# EasyEDA Pro project wukong01-Y003-HTOL.eprj, board PCB1 (continued)
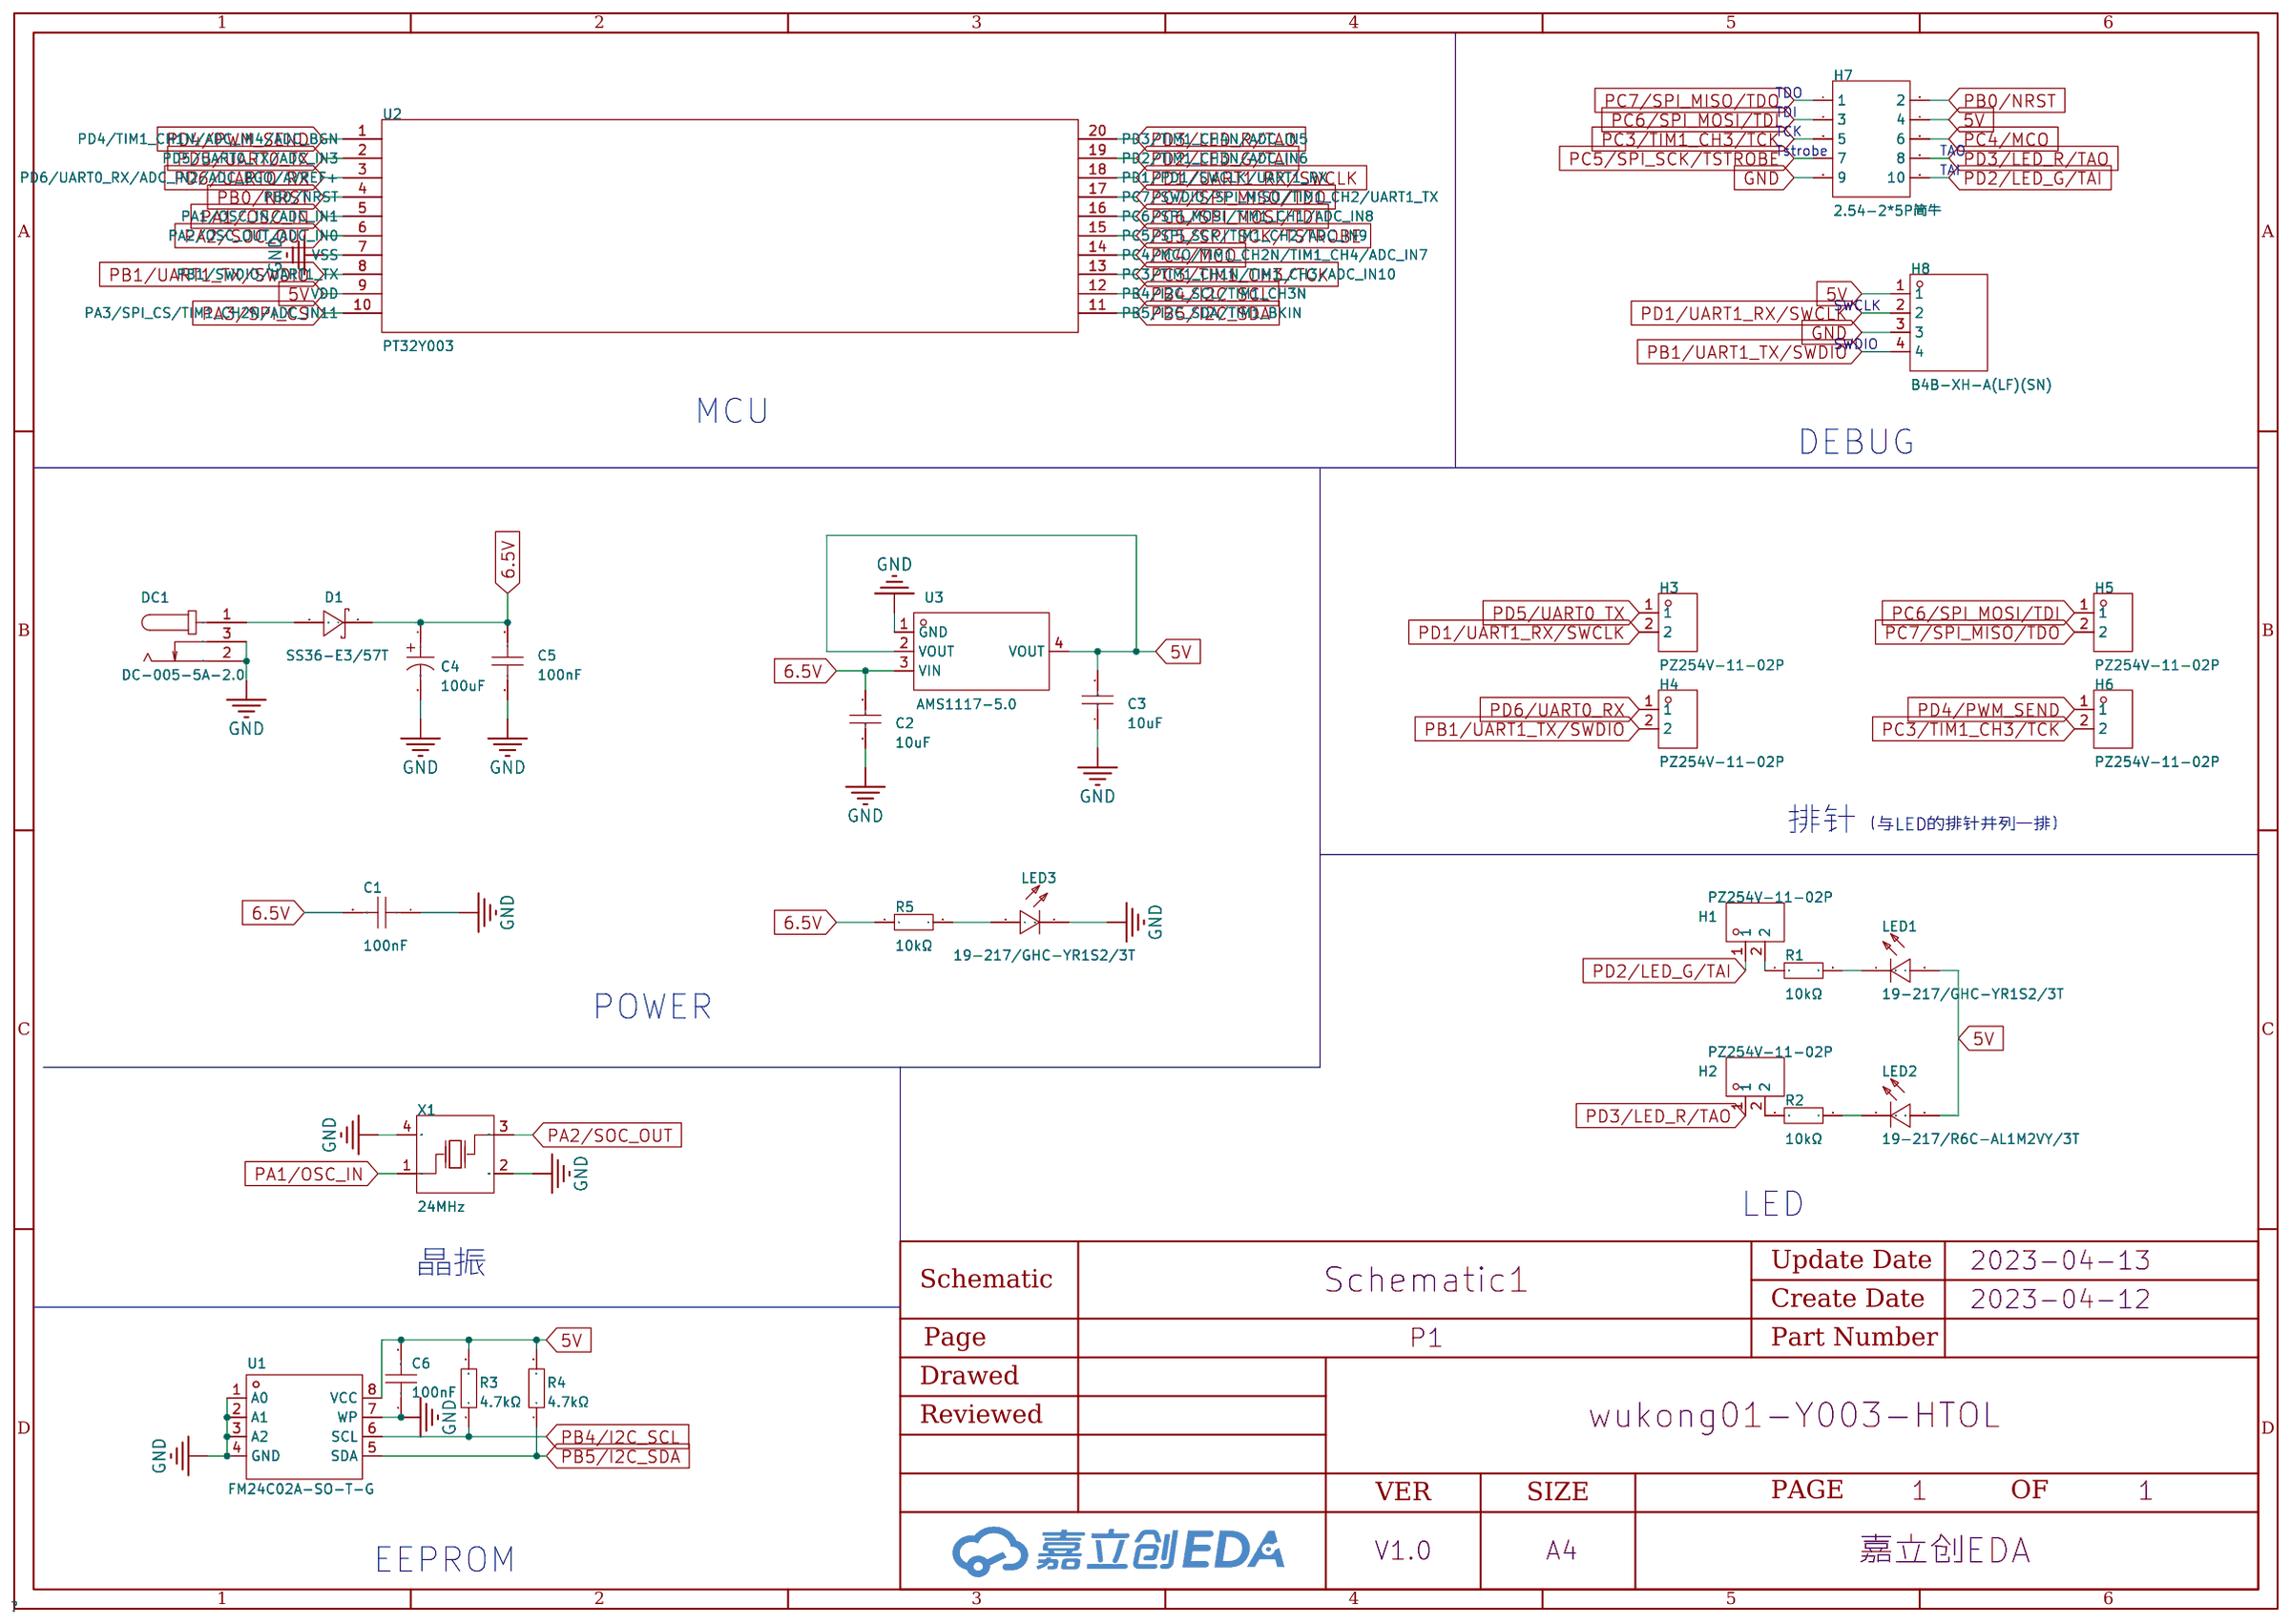
[diagram p0: schematic sheet]
## Routing (per net, layer and track width the routed paths; a pad name or vN(x,y) marks a point on that pad's centre or on a via; arc(x,y) is an arc through that point) (continued)
PC5/SPI_SCK/TSTROBE: length 727.1
  Top Layer w0.254: v1(37.34,102.62) 32.79,102.62 U2#8.15 ; v1(86.36,280.67) 86.36,280.92 81.91,285.37 H7#7.7 ; v1(282.45,151.89) 282.45,152.15 278,156.59 277.37,156.59 ; v1(37.34,231.39) 32.79,231.39 U2#29.15 ; v1(233.43,188.47) 228.88,188.47 U2#32.15 ; v1(233.43,151.89) 233.43,152.15 228.98,156.59 228.35,156.59 ; v1(233.43,237.74) 233.43,238 228.98,242.44 H7#27.7 ; v1(282.45,188.47) 277.9,188.47 U2#31.15 ; 179.32,156.59 179.96,156.59 184.4,152.15 v1(184.4,151.89) ; v1(135.38,145.54) 130.83,145.54 130.76,145.47 ; U2#35.15 32.79,188.47 v1(37.34,188.47) ; v1(184.4,102.62) 179.85,102.62 U2#6.15 ; v1(282.45,274.32) 277.9,274.32 U2#13.15 ; v1(135.38,231.39) 130.83,231.39 130.76,231.32 ; 130.3,285.37 130.94,285.37 135.38,280.92 v1(135.38,280.67) ; v1(86.36,66.04) 86.36,66.29 81.91,70.74 H7#15.7 ; v1(184.4,274.32) 179.85,274.32 U2#10.15 ; v1(282.45,102.62) 277.9,102.62 U2#3.15 ; H7#26.7 278,242.44 282.45,238 v1(282.45,237.74) ; 81.28,113.67 81.91,113.67 86.36,109.22 v1(86.36,108.97) ; v1(86.36,145.54) 81.81,145.54 U2#39.15 ; v1(135.38,237.74) 135.38,238 130.94,242.44 130.3,242.44 ; v1(184.4,108.97) 184.4,109.22 179.96,113.67 179.32,113.67 ; v1(37.34,66.04) 37.34,66.29 32.89,70.74 H7#12.7 ; v1(86.36,188.47) 81.81,188.47 U2#33.15 ; v1(37.34,59.69) 32.79,59.69 32.72,59.62 ; 179.32,27.81 179.96,27.81 184.4,23.37 v1(184.4,23.11) ; 228.35,113.67 228.98,113.67 233.43,109.22 v1(233.43,108.97) ; H7#33.7 228.98,199.52 233.43,195.07 v1(233.43,194.82) ; v1(233.43,66.04) 233.43,66.29 228.98,70.74 H7#22.7 ; v1(135.38,151.89) 135.38,152.15 130.94,156.59 130.3,156.59 ; U2#25.15 277.9,231.39 v1(282.45,231.39) ; U2#4.15 228.88,102.62 v1(233.43,102.62) ; U2#37.15 277.9,145.54 v1(282.45,145.54) ; v1(184.4,145.54) 179.85,145.54 U2#40.15 ; 228.8,59.62 228.88,59.69 v1(233.43,59.69) ; v1(37.34,16.76) 32.79,16.76 U2#22.15 ; v1(37.34,108.97) 37.34,109.22 32.89,113.67 32.26,113.67 ; H7#10.7 278,285.37 282.45,280.92 v1(282.45,280.67) ; v1(184.4,59.69) 179.85,59.69 179.78,59.62 ; H7#14.7 228.98,285.37 233.43,280.92 v1(233.43,280.67) ; v1(184.4,188.47) 179.85,188.47 U2#34.15 ; v1(135.38,66.04) 135.38,66.29 130.94,70.74 130.3,70.74 ; v1(184.4,237.74) 184.4,238 179.96,242.44 179.32,242.44 ; v1(37.34,237.74) 37.34,238 32.89,242.44 H7#28.7 ; v1(86.36,194.82) 86.36,195.07 81.91,199.52 H7#30.7 ; 277.83,59.62 277.9,59.69 v1(282.45,59.69) ; v1(184.4,231.39) 179.85,231.39 U2#28.15 ; 130.76,59.62 130.83,59.69 v1(135.38,59.69) ; v1(184.4,280.67) 184.4,280.92 179.96,285.37 179.32,285.37 ; v1(282.45,66.04) 282.45,66.29 278,70.74 H7#13.7 ; v1(86.36,16.76) 81.81,16.76 U2#23.15 ; 81.74,59.62 81.81,59.69 v1(86.36,59.69) ; v1(282.45,108.97) 282.45,109.22 278,113.67 277.37,113.67 ; v1(86.36,231.39) 81.81,231.39 U2#27.15 ; U2#26.15 228.88,231.39 v1(233.43,231.39) ; v1(184.4,16.76) 179.85,16.76 U2#17.15 ; 179.32,70.74 179.96,70.74 184.4,66.29 v1(184.4,66.04) ; 130.3,199.52 130.94,199.52 135.38,195.07 v1(135.38,194.82) ; U2#9.15 81.81,274.32 v1(86.36,274.32) ; 130.76,16.69 130.83,16.76 v1(135.38,16.76) ; v1(135.38,23.11) 135.38,23.37 130.94,27.81 130.3,27.81 ; 130.76,102.55 130.83,102.62 v1(135.38,102.62) ; U2#16.15 228.88,274.32 v1(233.43,274.32) ; v1(86.36,151.89) 86.36,152.15 81.91,156.59 81.28,156.59 ; 130.76,274.25 130.83,274.32 v1(135.38,274.32) ; 130.3,113.67 130.94,113.67 135.38,109.22 v1(135.38,108.97) ; v1(233.43,145.54) 228.88,145.54 U2#38.15 ; 32.26,156.59 32.89,156.59 37.34,152.15 v1(37.34,151.89) ; v1(282.45,194.82) 282.45,195.07 278,199.52 H7#32.7 ; U2#21.15 228.88,16.76 v1(233.43,16.76) ; v1(37.34,23.11) 37.34,23.37 32.89,27.81 32.26,27.81 ; v1(86.36,237.74) 86.36,238 81.91,242.44 H7#24.7 ; v1(184.4,194.82) 184.4,195.07 179.96,199.52 179.32,199.52 ; v1(135.38,188.47) 130.83,188.47 130.76,188.4 ; v1(233.43,23.11) 233.43,23.37 228.98,27.81 228.35,27.81 ; v1(86.36,23.11) 86.36,23.37 81.91,27.81 81.28,27.81 ; v1(37.34,194.82) 37.34,195.07 32.89,199.52 H7#34.7 ; v1(37.34,145.54) 32.79,145.54 U2.15 ; U2#5.15 81.81,102.62 v1(86.36,102.62)
  Bottom Layer w0.254: v1(37.34,145.54) v1(37.34,151.89) ; v1(86.36,16.76) v1(86.36,23.11) ; v1(233.43,102.62) v1(233.43,108.97) ; v1(135.38,188.47) v1(135.38,194.82) ; v1(37.34,16.76) v1(37.34,23.11) ; v1(184.4,188.47) v1(184.4,194.82) ; v1(233.43,59.69) v1(233.43,66.04) ; v1(135.38,274.32) v1(135.38,280.67) ; v1(233.43,188.47) v1(233.43,194.82) ; v1(233.43,16.76) v1(233.43,23.11) ; v1(86.36,274.32) v1(86.36,280.67) ; v1(135.38,59.69) v1(135.38,66.04) ; v1(184.4,231.39) v1(184.4,237.74) ; v1(282.45,231.39) v1(282.45,237.74) ; v1(135.38,16.76) v1(135.38,23.11) ; v1(282.45,59.69) v1(282.45,66.04) ; v1(184.4,16.76) v1(184.4,23.11) ; v1(37.34,231.39) v1(37.34,237.74) ; v1(282.45,188.47) v1(282.45,194.82) ; v1(37.34,59.69) v1(37.34,66.04) ; v1(282.45,102.62) v1(282.45,108.97) ; v1(135.38,231.39) v1(135.38,237.74) ; v1(86.36,145.54) v1(86.36,151.89) ; v1(37.34,102.62) v1(37.34,108.97) ; v1(233.43,274.32) v1(233.43,280.67) ; v1(184.4,145.54) v1(184.4,151.89) ; v1(86.36,188.47) v1(86.36,194.82) ; v1(135.38,102.62) v1(135.38,108.97) ; v1(184.4,274.32) v1(184.4,280.67) ; v1(233.43,145.54) v1(233.43,151.89) ; v1(233.43,231.39) v1(233.43,237.74) ; v1(86.36,59.69) v1(86.36,66.04) ; v1(282.45,274.32) v1(282.45,280.67) ; v1(86.36,231.39) v1(86.36,237.74) ; v1(86.36,102.62) v1(86.36,108.97) ; v1(135.38,145.54) v1(135.38,151.89) ; v1(184.4,102.62) v1(184.4,108.97) ; v1(184.4,59.69) v1(184.4,66.04) ; v1(37.34,188.47) v1(37.34,194.82) ; v1(282.45,145.54) v1(282.45,151.89)
PC6/SPI_MOSI/TDI: length 1347.5
  Top Layer w0.254: H5#18.1 191.2,10.92 184.72,17.4 v1(183.26,17.4) 183.21,17.34 U2#17.16 ; 27.18,70.74 27.18,67.44 27.81,66.8 35.43,66.8 v1(36.2,66.04) ; H5#9.1 191.2,268.48 184.72,274.96 v1(183.26,274.96) 183.21,274.9 U2#10.16 ; U2.16 36.14,146.12 v1(36.2,146.18) 37.66,146.18 44.13,139.7 H5#39.1 ; 130.76,60.27 134.18,60.27 v1(134.24,60.33) 135.7,60.33 142.18,53.85 H5#23.1 ; v1(183.26,23.11) 182.5,23.88 174.88,23.88 174.24,24.51 174.24,27.81 ; 272.29,113.67 272.29,110.36 272.92,109.73 280.54,109.73 v1(281.31,108.97) ; H5#19.1 142.18,10.92 135.7,17.4 v1(134.24,17.4) 134.18,17.34 130.76,17.34 ; H5#2.1 191.2,96.77 184.72,103.25 v1(183.26,103.25) 183.21,103.2 U2#6.16 ; 223.27,199.52 223.27,196.22 223.9,195.58 231.52,195.58 v1(232.28,194.82) ; U2#23.16 85.16,17.34 v1(85.22,17.4) 86.68,17.4 93.16,10.92 H5#14.1 ; v1(232.28,280.67) 231.52,281.43 223.9,281.43 223.27,282.07 223.27,285.37 ; H7#8.3 174.24,282.07 174.88,281.43 182.5,281.43 v1(183.26,280.67) ; U2#33.16 85.16,189.05 v1(85.22,189.1) 86.68,189.1 93.16,182.63 H5#32.1 ; U2#7.16 183.21,60.27 v1(183.26,60.33) 184.72,60.33 191.2,53.85 H5#16.1 ; v1(281.31,280.67) 280.54,281.43 272.92,281.43 272.29,282.07 H7#10.3 ; 174.24,156.59 174.24,153.29 174.88,152.65 182.5,152.65 v1(183.26,151.89) ; 27.18,199.52 27.18,196.22 27.81,195.58 35.43,195.58 v1(36.2,194.82) ; H5#4.1 93.16,96.77 86.68,103.25 v1(85.22,103.25) 85.16,103.2 U2#5.16 ; 130.76,274.9 134.18,274.9 v1(134.24,274.96) 135.7,274.96 142.18,268.48 H5#10.1 ; H5#38.1 93.16,139.7 86.68,146.18 v1(85.22,146.18) 85.16,146.12 U2#39.16 ; U2#37.16 281.25,146.12 v1(281.31,146.18) 282.77,146.18 289.24,139.7 H5#37.1 ; v1(85.22,194.82) 84.45,195.58 76.83,195.58 76.2,196.22 76.2,199.52 ; v1(232.28,66.04) 231.52,66.8 223.9,66.8 223.27,67.44 223.27,70.74 ; 223.27,156.59 223.27,153.29 223.9,152.65 231.52,152.65 v1(232.28,151.89) ; H7#25.3 174.24,239.14 174.88,238.51 182.5,238.51 v1(183.26,237.74) ; H5#34.1 240.22,182.63 233.74,189.1 v1(232.28,189.1) 232.23,189.05 U2#32.16 ; v1(183.26,66.04) 182.5,66.8 174.88,66.8 174.24,67.44 H7#16.3 ; U2#26.16 232.23,231.97 v1(232.28,232.03) 233.74,232.03 240.22,225.55 H5#28.1 ; 130.76,231.97 134.18,231.97 v1(134.24,232.03) 135.7,232.03 142.18,225.55 H5#29.1 ; 125.22,113.67 125.22,110.36 125.86,109.73 133.48,109.73 v1(134.24,108.97) ; H7#23.3 125.22,239.14 125.86,238.51 133.48,238.51 v1(134.24,237.74) ; H5#30.1 191.2,182.63 184.72,189.1 v1(183.26,189.1) 183.21,189.05 U2#34.16 ; v1(183.26,108.97) 182.5,109.73 174.88,109.73 174.24,110.36 174.24,113.67 ; U2#16.16 232.23,274.9 v1(232.28,274.96) 233.74,274.96 240.22,268.48 H5#12.1 ; 76.2,156.59 76.2,153.29 76.83,152.65 84.45,152.65 v1(85.22,151.89) ; U2#8.16 36.14,103.2 v1(36.2,103.25) 37.66,103.25 44.13,96.77 H5#5.1 ; U2#28.16 183.21,231.97 v1(183.26,232.03) 184.72,232.03 191.2,225.55 H5#24.1 ; v1(85.22,280.67) 84.45,281.43 76.83,281.43 76.2,282.07 76.2,285.37 ; 27.18,113.67 27.18,110.36 27.81,109.73 35.43,109.73 v1(36.2,108.97) ; v1(134.24,66.04) 133.48,66.8 125.86,66.8 125.22,67.44 H7#17.3 ; H7#32.3 272.29,196.22 272.92,195.58 280.54,195.58 v1(281.31,194.82) ; H5#25.1 289.24,225.55 282.77,232.03 v1(281.31,232.03) 281.25,231.97 U2#25.16 ; v1(85.22,66.04) 84.45,66.8 76.83,66.8 76.2,67.44 76.2,70.74 ; H5#15.1 93.16,53.85 86.68,60.33 v1(85.22,60.33) 85.16,60.27 U2#14.16 ; U2#21.16 232.23,17.34 v1(232.28,17.4) 233.74,17.4 240.22,10.92 H5#17.1 ; 125.22,156.59 125.22,153.29 125.86,152.65 133.48,152.65 v1(134.24,151.89) ; H5#36.1 191.2,139.7 184.72,146.18 v1(183.26,146.18) 183.21,146.12 U2#40.16 ; v1(36.2,151.89) 35.43,152.65 27.81,152.65 27.18,153.29 27.18,156.59 ; v1(36.2,23.11) 35.43,23.88 27.81,23.88 27.18,24.51 27.18,27.81 ; U2#13.16 281.25,274.9 v1(281.31,274.96) 282.77,274.96 289.24,268.48 H5#11.1 ; v1(134.24,280.67) 133.48,281.43 125.86,281.43 125.22,282.07 H7#9.3 ; H5#40.1 240.22,139.7 233.74,146.18 v1(232.28,146.18) 232.23,146.12 U2#38.16 ; U2#29.16 36.14,231.97 v1(36.2,232.03) 37.66,232.03 44.13,225.55 H5#27.1 ; U2#19.16 232.23,60.27 v1(232.28,60.33) 233.74,60.33 240.22,53.85 H5#20.1 ; U2#3.16 281.25,103.2 v1(281.31,103.25) 282.77,103.25 289.24,96.77 H5#3.1 ; U2#27.16 85.16,231.97 v1(85.22,232.03) 86.68,232.03 93.16,225.55 H5#26.1 ; H5#6.1 240.22,96.77 233.74,103.25 v1(232.28,103.25) 232.23,103.2 U2#4.16 ; H5#7.1 142.18,96.77 135.7,103.25 v1(134.24,103.25) 134.18,103.2 130.76,103.2 ; H7#29.3 125.22,196.22 125.86,195.58 133.48,195.58 v1(134.24,194.82) ; v1(281.31,151.89) 280.54,152.65 272.92,152.65 272.29,153.29 272.29,156.59 ; H5#13.1 289.24,53.85 282.77,60.33 v1(281.31,60.33) 281.25,60.27 U2#12.16 ; H7#31.3 174.24,196.22 174.88,195.58 182.5,195.58 v1(183.26,194.82) ; 223.27,113.67 223.27,110.36 223.9,109.73 231.52,109.73 v1(232.28,108.97) ; H5#21.1 44.13,10.92 37.66,17.4 v1(36.2,17.4) 36.14,17.34 U2#22.16 ; H5#31.1 289.24,182.63 282.77,189.1 v1(281.31,189.1) 281.25,189.05 U2#31.16 ; v1(232.28,23.11) 231.52,23.88 223.9,23.88 223.27,24.51 223.27,27.81 ; 76.2,113.67 76.2,110.36 76.83,109.73 84.45,109.73 v1(85.22,108.97) ; 27.18,242.44 27.18,239.14 27.81,238.51 35.43,238.51 v1(36.2,237.74) ; H5#35.1 142.18,182.63 135.7,189.1 v1(134.24,189.1) 134.18,189.05 130.76,189.05 ; H5#8.1 93.16,268.48 86.68,274.96 v1(85.22,274.96) 85.16,274.9 U2#9.16 ; U2#20.16 36.14,60.27 v1(36.2,60.33) 37.66,60.33 44.13,53.85 H5#22.1 ; H5.1 142.18,139.7 135.7,146.18 v1(134.24,146.18) 134.18,146.12 130.76,146.12 ; 125.22,27.81 125.22,24.51 125.86,23.88 133.48,23.88 v1(134.24,23.11) ; U2#35.16 36.14,189.05 v1(36.2,189.1) 37.66,189.1 44.13,182.63 H5#33.1 ; H7#26.3 272.29,239.14 272.92,238.51 280.54,238.51 v1(281.31,237.74) ; v1(85.22,23.11) 84.45,23.88 76.83,23.88 76.2,24.51 76.2,27.81 ; H7#13.3 272.29,67.44 272.92,66.8 280.54,66.8 v1(281.31,66.04) ; v1(85.22,237.74) 84.45,238.51 76.83,238.51 76.2,239.14 76.2,242.44 ; 223.27,242.44 223.27,239.14 223.9,238.51 231.52,238.51 v1(232.28,237.74)
  Bottom Layer w0.254: v1(134.24,189.1) v1(134.24,194.82) ; v1(183.26,189.1) v1(183.26,194.82) ; v1(281.31,189.1) v1(281.31,194.82) ; v1(183.26,274.96) v1(183.26,280.67) ; v1(232.28,189.1) v1(232.28,194.82) ; v1(134.24,274.96) v1(134.24,280.67) ; v1(85.22,274.96) v1(85.22,280.67) ; v1(281.31,274.96) v1(281.31,280.67) ; v1(134.24,17.4) v1(134.24,23.11) ; v1(183.26,232.03) v1(183.26,237.74) ; v1(85.22,17.4) v1(85.22,23.11) ; v1(281.31,232.03) v1(281.31,237.74) ; v1(134.24,60.33) v1(134.24,66.04) ; v1(232.28,274.96) v1(232.28,280.67) ; v1(281.31,60.33) v1(281.31,66.04) ; v1(85.22,232.03) v1(85.22,237.74) ; v1(85.22,103.25) v1(85.22,108.97) ; v1(85.22,189.1) v1(85.22,194.82) ; v1(85.22,60.33) v1(85.22,66.04) ; v1(36.2,60.33) v1(36.2,66.04) ; v1(134.24,146.18) v1(134.24,151.89) ; v1(36.2,189.1) v1(36.2,194.82) ; v1(232.28,103.25) v1(232.28,108.97) ; v1(183.26,17.4) v1(183.26,23.11) ; v1(36.2,17.4) v1(36.2,23.11) ; v1(134.24,232.03) v1(134.24,237.74) ; v1(232.28,17.4) v1(232.28,23.11) ; v1(232.28,232.03) v1(232.28,237.74) ; v1(134.24,103.25) v1(134.24,108.97) ; v1(183.26,146.18) v1(183.26,151.89) ; v1(183.26,60.33) v1(183.26,66.04) ; v1(36.2,232.03) v1(36.2,237.74) ; v1(36.2,103.25) v1(36.2,108.97) ; v1(85.22,146.18) v1(85.22,151.89) ; v1(232.28,146.18) v1(232.28,151.89) ; v1(281.31,146.18) v1(281.31,151.89) ; v1(36.2,146.18) v1(36.2,151.89) ; v1(183.26,103.25) v1(183.26,108.97) ; v1(232.28,60.33) v1(232.28,66.04) ; v1(281.31,103.25) v1(281.31,108.97)
PC7/SPI_MISO/TDO: length 1602.9
  Top Layer w0.254: H7#7.1 73.66,281.56 74.3,280.92 83.82,280.92 v1(84.07,280.67) ; 130.76,146.77 130.8,146.81 v1(133.1,146.81) ; v1(87.12,185.8) 91.82,181.1 96.39,181.1 96.65,181.36 H5#32.2 ; v1(87.12,271.65) 91.82,266.95 96.39,266.95 96.65,267.21 H5#8.2 ; v1(35.05,194.82) 34.8,195.07 25.27,195.07 24.64,195.71 24.64,199.52 ; v1(231.14,275.59) 228.84,275.59 U2#16.17 ; H5#13.2 292.74,52.58 292.48,52.32 287.91,52.32 v1(283.21,57.02) ; H5#9.2 194.69,267.21 194.44,266.95 189.87,266.95 v1(185.17,271.65) ; 122.68,113.67 122.68,109.86 123.32,109.22 132.84,109.22 v1(133.1,108.97) ; H5#34.2 243.71,181.36 243.46,181.1 238.89,181.1 v1(234.19,185.8) ; H5#15.2 96.65,52.58 96.39,52.32 91.82,52.32 v1(87.12,57.02) ; v1(133.1,280.67) 132.84,280.92 123.32,280.92 122.68,281.56 H7#9.1 ; 73.66,113.67 73.66,109.86 74.3,109.22 83.82,109.22 v1(84.07,108.97) ; v1(280.16,275.59) 277.87,275.59 U2#13.17 ; v1(231.14,189.74) 228.84,189.74 228.8,189.7 ; 81.74,17.99 81.78,18.03 v1(84.07,18.03) ; v1(133.1,237.74) 132.84,238 123.32,238 122.68,238.63 H7#23.1 ; U2#8.17 32.76,103.89 v1(35.05,103.89) ; U2#20.17 32.76,60.96 v1(35.05,60.96) ; 269.75,113.67 269.75,109.86 270.38,109.22 279.91,109.22 v1(280.16,108.97) ; v1(38.1,14.1) 42.8,9.4 47.37,9.4 47.62,9.65 H5#21.2 ; v1(234.19,14.1) 238.89,9.4 243.46,9.4 243.71,9.65 H5#17.2 ; H7#10.1 269.75,281.56 270.38,280.92 279.91,280.92 v1(280.16,280.67) ; v1(84.07,66.04) 83.82,66.29 74.3,66.29 73.66,66.93 H7#15.1 ; H5#12.2 243.71,267.21 243.46,266.95 238.89,266.95 v1(234.19,271.65) ; v1(35.05,23.11) 34.8,23.37 25.27,23.37 24.64,24 24.64,27.81 ; H5#31.2 292.74,181.36 292.48,181.1 287.91,181.1 v1(283.21,185.8) ; H5#33.2 47.62,181.36 47.37,181.1 42.8,181.1 v1(38.1,185.8) ; H5#27.2 47.62,224.28 47.37,224.03 42.8,224.03 v1(38.1,228.73) ; v1(38.1,57.02) 42.8,52.32 47.37,52.32 47.62,52.58 H5#22.2 ; v1(35.05,146.81) 32.76,146.81 U2.17 ; H5#18.2 194.69,9.65 194.44,9.4 189.87,9.4 v1(185.17,14.1) ; v1(133.1,194.82) 132.84,195.07 123.32,195.07 122.68,195.71 H7#29.1 ; v1(182.12,189.74) 179.82,189.74 179.78,189.7 ; 171.7,156.59 171.7,152.78 172.34,152.15 181.86,152.15 v1(182.12,151.89) ; U2#10.17 179.82,275.59 v1(182.12,275.59) ; v1(87.12,99.95) 91.82,95.25 96.39,95.25 96.65,95.5 H5#4.2 ; v1(280.16,189.74) 277.87,189.74 277.83,189.7 ; v1(231.14,23.11) 230.89,23.37 221.36,23.37 220.73,24 220.73,27.81 ; U2#26.17 228.84,232.66 v1(231.14,232.66) ; 171.7,113.67 171.7,109.86 172.34,109.22 181.86,109.22 v1(182.12,108.97) ; U2#14.17 81.78,60.96 v1(84.07,60.96) ; v1(182.12,23.11) 181.86,23.37 172.34,23.37 171.7,24 171.7,27.81 ; v1(133.1,103.89) 130.8,103.89 130.76,103.84 ; H5#14.2 96.65,9.65 96.39,9.4 91.82,9.4 v1(87.12,14.1) ; v1(182.12,194.82) 181.86,195.07 172.34,195.07 171.7,195.71 171.7,199.52 ; U2#7.17 179.82,60.96 v1(182.12,60.96) ; v1(136.14,99.95) 140.84,95.25 145.41,95.25 145.67,95.5 H5#7.2 ; 32.72,17.99 32.76,18.03 v1(35.05,18.03) ; v1(133.1,232.66) 130.8,232.66 130.76,232.62 ; 269.75,156.59 269.75,152.78 270.38,152.15 279.91,152.15 v1(280.16,151.89) ; v1(234.19,99.95) 238.89,95.25 243.46,95.25 243.71,95.5 H5#6.2 ; v1(35.05,66.04) 34.8,66.29 25.27,66.29 24.64,66.93 24.64,70.74 ; v1(182.12,66.04) 181.86,66.29 172.34,66.29 171.7,66.93 171.7,70.74 ; v1(84.07,151.89) 83.82,152.15 74.3,152.15 73.66,152.78 73.66,156.59 ; 24.64,113.67 24.64,109.86 25.27,109.22 34.8,109.22 v1(35.05,108.97) ; v1(231.14,146.81) 228.84,146.81 U2#38.17 ; v1(136.14,271.65) 140.84,266.95 145.41,266.95 145.67,267.21 H5#10.2 ; 171.7,285.37 171.7,281.56 172.34,280.92 181.86,280.92 v1(182.12,280.67) ; v1(280.16,103.89) 277.87,103.89 U2#3.17 ; v1(87.12,142.88) 91.82,138.18 96.39,138.18 96.65,138.43 H5#38.2 ; v1(182.12,237.74) 181.86,238 172.34,238 171.7,238.63 171.7,242.44 ; 130.76,189.7 130.8,189.74 v1(133.1,189.74) ; v1(185.17,185.8) 189.87,181.1 194.44,181.1 194.69,181.36 H5#30.2 ; H5#5.2 47.62,95.5 47.37,95.25 42.8,95.25 v1(38.1,99.95) ; H5#3.2 292.74,95.5 292.48,95.25 287.91,95.25 v1(283.21,99.95) ; v1(35.05,237.74) 34.8,238 25.27,238 24.64,238.63 24.64,242.44 ; H5#35.2 145.67,181.36 145.41,181.1 140.84,181.1 v1(136.14,185.8) ; 73.66,27.81 73.66,24 74.3,23.37 83.82,23.37 v1(84.07,23.11) ; H7#30.1 73.66,195.71 74.3,195.07 83.82,195.07 v1(84.07,194.82) ; H5#29.2 145.67,224.28 145.41,224.03 140.84,224.03 v1(136.14,228.73) ; v1(280.16,66.04) 279.91,66.29 270.38,66.29 269.75,66.93 H7#13.1 ; v1(283.21,271.65) 287.91,266.95 292.48,266.95 292.74,267.21 H5#11.2 ; U2#6.17 179.82,103.89 v1(182.12,103.89) ; v1(280.16,237.74) 279.91,238 270.38,238 269.75,238.63 H7#26.1 ; H7#27.1 220.73,238.63 221.36,238 230.89,238 v1(231.14,237.74) ; v1(234.19,228.73) 238.89,224.03 243.46,224.03 243.71,224.28 H5#28.2 ; v1(136.14,142.88) 140.84,138.18 145.41,138.18 145.67,138.43 H5.2 ; 130.76,60.92 130.8,60.96 v1(133.1,60.96) ; 130.76,275.55 130.8,275.59 v1(133.1,275.59) ; v1(84.07,275.59) 81.78,275.59 U2#9.17 ; U2#37.17 277.87,146.81 v1(280.16,146.81) ; v1(231.14,194.82) 230.89,195.07 221.36,195.07 220.73,195.71 H7#33.1 ; v1(133.1,66.04) 132.84,66.29 123.32,66.29 122.68,66.93 H7#17.1 ; H5#24.2 194.69,224.28 194.44,224.03 189.87,224.03 v1(185.17,228.73) ; H5#2.2 194.69,95.5 194.44,95.25 189.87,95.25 v1(185.17,99.95) ; v1(234.19,57.02) 238.89,52.32 243.46,52.32 243.71,52.58 H5#20.2 ; 81.74,189.7 81.78,189.74 v1(84.07,189.74) ; v1(87.12,228.73) 91.82,224.03 96.39,224.03 96.65,224.28 H5#26.2 ; H7#14.1 220.73,281.56 221.36,280.92 230.89,280.92 v1(231.14,280.67) ; 130.76,17.99 130.8,18.03 v1(133.1,18.03) ; U2#27.17 81.78,232.66 v1(84.07,232.66) ; U2#25.17 277.87,232.66 v1(280.16,232.66) ; 32.72,189.7 32.76,189.74 v1(35.05,189.74) ; v1(38.1,142.88) 42.8,138.18 47.37,138.18 47.62,138.43 H5#39.2 ; H7#32.1 269.75,195.71 270.38,195.07 279.91,195.07 v1(280.16,194.82) ; H7#22.1 220.73,66.93 221.36,66.29 230.89,66.29 v1(231.14,66.04) ; H5#23.2 145.67,52.58 145.41,52.32 140.84,52.32 v1(136.14,57.02) ; v1(133.1,23.11) 132.84,23.37 123.32,23.37 122.68,24 122.68,27.81 ; U2#28.17 179.82,232.66 v1(182.12,232.66) ; 179.78,17.99 179.82,18.03 v1(182.12,18.03) ; v1(231.14,60.96) 228.84,60.96 U2#19.17 ; H5#37.2 292.74,138.43 292.48,138.18 287.91,138.18 v1(283.21,142.88) ; H7#24.1 73.66,238.63 74.3,238 83.82,238 v1(84.07,237.74) ; H5#19.2 145.67,9.65 145.41,9.4 140.84,9.4 v1(136.14,14.1) ; U2#40.17 179.82,146.81 v1(182.12,146.81) ; H5#36.2 194.69,138.43 194.44,138.18 189.87,138.18 v1(185.17,142.88) ; 220.73,156.59 220.73,152.78 221.36,152.15 230.89,152.15 v1(231.14,151.89) ; v1(133.1,151.89) 132.84,152.15 123.32,152.15 122.68,152.78 122.68,156.59 ; U2#39.17 81.78,146.81 v1(84.07,146.81) ; v1(84.07,103.89) 81.78,103.89 U2#5.17 ; v1(35.05,151.89) 34.8,152.15 25.27,152.15 24.64,152.78 24.64,156.59 ; U2#29.17 32.76,232.66 v1(35.05,232.66) ; 220.73,113.67 220.73,109.86 221.36,109.22 230.89,109.22 v1(231.14,108.97) ; v1(283.21,228.73) 287.91,224.03 292.48,224.03 292.74,224.28 H5#25.2 ; H5#16.2 194.69,52.58 194.44,52.32 189.87,52.32 v1(185.17,57.02) ; v1(231.14,103.89) 228.84,103.89 U2#4.17 ; H5#40.2 243.71,138.43 243.46,138.18 238.89,138.18 v1(234.19,142.88) ; U2#12.17 277.87,60.96 v1(280.16,60.96) ; v1(231.14,18.03) 228.84,18.03 228.8,17.99
  Bottom Layer w0.254: v1(283.21,228.73) 283.21,228.8 280.16,231.85 v1(280.16,232.66) v1(280.16,237.74) ; v1(283.21,185.8) 283.21,185.88 280.16,188.93 v1(280.16,189.74) v1(280.16,194.82) ; v1(280.16,66.04) v1(280.16,60.96) 280.16,60.15 283.21,57.1 v1(283.21,57.02) ; v1(182.12,151.89) v1(182.12,146.81) 182.12,146 185.17,142.95 v1(185.17,142.88) ; v1(136.14,57.02) 136.14,57.1 133.1,60.15 v1(133.1,60.96) v1(133.1,66.04) ; v1(87.12,99.95) 87.12,100.03 84.07,103.07 v1(84.07,103.89) v1(84.07,108.97) ; v1(185.17,228.73) 185.17,228.8 182.12,231.85 v1(182.12,232.66) v1(182.12,237.74) ; v1(234.19,228.73) 234.19,228.8 231.14,231.85 v1(231.14,232.66) v1(231.14,237.74) ; v1(133.1,108.97) v1(133.1,103.89) 133.1,103.07 136.14,100.03 v1(136.14,99.95) ; v1(35.05,237.74) v1(35.05,232.66) 35.05,231.85 38.1,228.8 v1(38.1,228.73) ; v1(280.16,280.67) v1(280.16,275.59) 280.16,274.78 283.21,271.73 v1(283.21,271.65) ; v1(87.12,228.73) 87.12,228.8 84.07,231.85 v1(84.07,232.66) v1(84.07,237.74) ; v1(136.14,14.1) 136.14,14.17 133.1,17.22 v1(133.1,18.03) v1(133.1,23.11) ; v1(35.05,23.11) v1(35.05,18.03) 35.05,17.22 38.1,14.17 v1(38.1,14.1) ; v1(231.14,108.97) v1(231.14,103.89) 231.14,103.07 234.19,100.03 v1(234.19,99.95) ; v1(231.14,23.11) v1(231.14,18.03) 231.14,17.22 234.19,14.17 v1(234.19,14.1) ; v1(136.14,142.88) 136.14,142.95 133.1,146 v1(133.1,146.81) v1(133.1,151.89) ; v1(231.14,151.89) v1(231.14,146.81) 231.14,146 234.19,142.95 v1(234.19,142.88) ; v1(84.07,66.04) v1(84.07,60.96) 84.07,60.15 87.12,57.1 v1(87.12,57.02) ; v1(87.12,14.1) 87.12,14.17 84.07,17.22 v1(84.07,18.03) v1(84.07,23.11) ; v1(87.12,185.8) 87.12,185.88 84.07,188.93 v1(84.07,189.74) v1(84.07,194.82) ; v1(87.12,271.65) 87.12,271.73 84.07,274.78 v1(84.07,275.59) v1(84.07,280.67) ; v1(38.1,142.88) 38.1,142.95 35.05,146 v1(35.05,146.81) v1(35.05,151.89) ; v1(84.07,151.89) v1(84.07,146.81) 84.07,146 87.12,142.95 v1(87.12,142.88) ; v1(38.1,57.02) 38.1,57.1 35.05,60.15 v1(35.05,60.96) v1(35.05,66.04) ; v1(38.1,185.8) 38.1,185.88 35.05,188.93 v1(35.05,189.74) v1(35.05,194.82) ; v1(182.12,194.82) v1(182.12,189.74) 182.12,188.93 185.17,185.88 v1(185.17,185.8) ; v1(136.14,228.73) 136.14,228.8 133.1,231.85 v1(133.1,232.66) v1(133.1,237.74) ; v1(234.19,271.65) 234.19,271.73 231.14,274.78 v1(231.14,275.59) v1(231.14,280.67) ; v1(231.14,194.82) v1(231.14,189.74) 231.14,188.93 234.19,185.88 v1(234.19,185.8) ; v1(133.1,194.82) v1(133.1,189.74) 133.1,188.93 136.14,185.88 v1(136.14,185.8) ; v1(182.12,66.04) v1(182.12,60.96) 182.12,60.15 185.17,57.1 v1(185.17,57.02) ; v1(280.16,108.97) v1(280.16,103.89) 280.16,103.07 283.21,100.03 v1(283.21,99.95) ; v1(185.17,271.65) 185.17,271.73 182.12,274.78 v1(182.12,275.59) v1(182.12,280.67) ; v1(185.17,14.1) 185.17,14.17 182.12,17.22 v1(182.12,18.03) v1(182.12,23.11) ; v1(234.19,57.02) 234.19,57.1 231.14,60.15 v1(231.14,60.96) v1(231.14,66.04) ; v1(280.16,151.89) v1(280.16,146.81) 280.16,146 283.21,142.95 v1(283.21,142.88) ; v1(136.14,271.65) 136.14,271.73 133.1,274.78 v1(133.1,275.59) v1(133.1,280.67) ; v1(185.17,99.95) 185.17,100.03 182.12,103.07 v1(182.12,103.89) v1(182.12,108.97) ; v1(38.1,99.95) 38.1,100.03 35.05,103.07 v1(35.05,103.89) v1(35.05,108.97)
PD1/UART1_RX/SWCLK: length 3806
  Top Layer w0.254: v1(101.73,127.64) v1(101.73,106.93) ; U2#37.18 282.47,147.42 v1(285.5,144.4) ; U2#7.18 184.43,61.57 v1(187.45,58.55) ; 130.76,61.57 135.41,61.57 v1(138.43,58.55) ; 130.76,147.42 135.41,147.42 v1(138.43,144.4) ; 228.8,233.27 233.45,233.27 v1(236.47,230.25) ; U2#5.18 86.39,104.5 v1(89.41,101.47) ; v1(89.41,187.33) 86.39,190.35 U2#33.18 ; U2#39.18 86.39,147.42 v1(89.41,144.4) ; v1(199.77,256.41) v1(199.77,235.71) ; v1(285.5,230.25) 282.47,233.27 277.83,233.27 ; v1(248.79,256.41) v1(248.79,235.71) ; v1(297.82,170.56) v1(297.82,149.86) ; U2#16.18 233.45,276.2 v1(236.47,273.18) ; U2#10.18 184.43,276.2 v1(187.45,273.18) ; v1(248.79,127.64) v1(248.79,106.93) ; v1(40.39,58.55) 37.36,61.57 U2#20.18 ; U2#9.18 86.39,276.2 v1(89.41,273.18) ; v1(52.7,256.41) v1(52.7,235.71) ; U2#34.18 184.43,190.35 v1(187.45,187.33) ; v1(187.45,101.47) 184.43,104.5 U2#6.18 ; v1(101.73,84.71) v1(101.73,64.01) ; v1(297.82,256.41) v1(297.82,235.71) ; U2#40.18 184.43,147.42 v1(187.45,144.4) ; U2#38.18 233.45,147.42 v1(236.47,144.4) ; v1(187.45,15.62) 184.43,18.64 U2#17.18 ; U2#3.18 282.47,104.5 v1(285.5,101.47) ; v1(248.79,84.71) v1(248.79,64.01) ; v1(150.75,256.41) v1(150.75,235.71) ; v1(101.73,299.34) v1(101.73,278.64) ; v1(236.47,58.55) 233.45,61.57 U2#19.18 ; U2#23.18 86.39,18.64 v1(89.41,15.62) ; v1(285.5,187.33) 282.47,190.35 U2#31.18 ; v1(285.5,58.55) 282.47,61.57 U2#12.18 ; 130.76,18.64 135.41,18.64 v1(138.43,15.62) ; v1(101.73,41.78) v1(101.73,21.08) ; v1(150.75,41.78) v1(150.75,21.08) ; 130.76,276.2 135.41,276.2 v1(138.43,273.18) ; v1(138.43,101.47) 135.41,104.5 130.76,104.5 ; v1(236.47,15.62) 233.45,18.64 U2#21.18 ; v1(89.41,58.55) 86.39,61.57 U2#14.18 ; v1(297.82,127.64) v1(297.82,106.93) ; U2#35.18 37.36,190.35 v1(40.39,187.33) ; 32.72,233.27 37.36,233.27 v1(40.39,230.25) ; v1(297.82,299.34) v1(297.82,278.64) ; v1(236.47,187.33) 233.45,190.35 U2#32.18 ; v1(40.39,101.47) 37.36,104.5 U2#8.18 ; v1(150.75,127.64) v1(150.75,106.93) ; U2.18 37.36,147.42 v1(40.39,144.4) ; v1(150.75,299.34) v1(150.75,278.64) ; v1(52.7,41.78) v1(52.7,21.08) ; v1(297.82,213.49) v1(297.82,192.79) ; v1(199.77,41.78) v1(199.77,21.08) ; U2#4.18 233.45,104.5 v1(236.47,101.47) ; 81.74,233.27 86.39,233.27 v1(89.41,230.25) ; v1(248.79,41.78) v1(248.79,21.08) ; v1(248.79,170.56) v1(248.79,149.86) ; v1(199.77,127.64) v1(199.77,106.93) ; v1(150.75,213.49) v1(150.75,192.79) ; v1(101.73,170.56) v1(101.73,149.86) ; v1(248.79,299.34) v1(248.79,278.64) ; v1(199.77,84.71) v1(199.77,64.01) ; v1(138.43,230.25) 135.41,233.27 130.76,233.27 ; v1(138.43,187.33) 135.41,190.35 130.76,190.35 ; v1(248.79,213.49) v1(248.79,192.79) ; v1(52.7,170.56) v1(52.7,149.86) ; v1(150.75,84.71) v1(150.75,64.01) ; v1(285.5,273.18) 282.47,276.2 U2#13.18 ; v1(101.73,213.49) v1(101.73,192.79) ; v1(52.7,127.64) v1(52.7,106.93) ; U2#22.18 37.36,18.64 v1(40.39,15.62) ; v1(150.75,170.56) v1(150.75,149.86) ; v1(199.77,213.49) v1(199.77,192.79) ; v1(297.82,84.71) v1(297.82,64.01) ; v1(101.73,256.41) v1(101.73,235.71) ; v1(199.77,170.56) v1(199.77,149.86) ; v1(52.7,84.71) v1(52.7,64.01) ; v1(187.45,230.25) 184.43,233.27 179.78,233.27 ; v1(199.77,299.34) v1(199.77,278.64) ; v1(52.7,213.49) v1(52.7,192.79)